# EasyEDA Pro project STM32G303的双FOC电机驱动.eprj, board motor_drivev1.3 (continued)
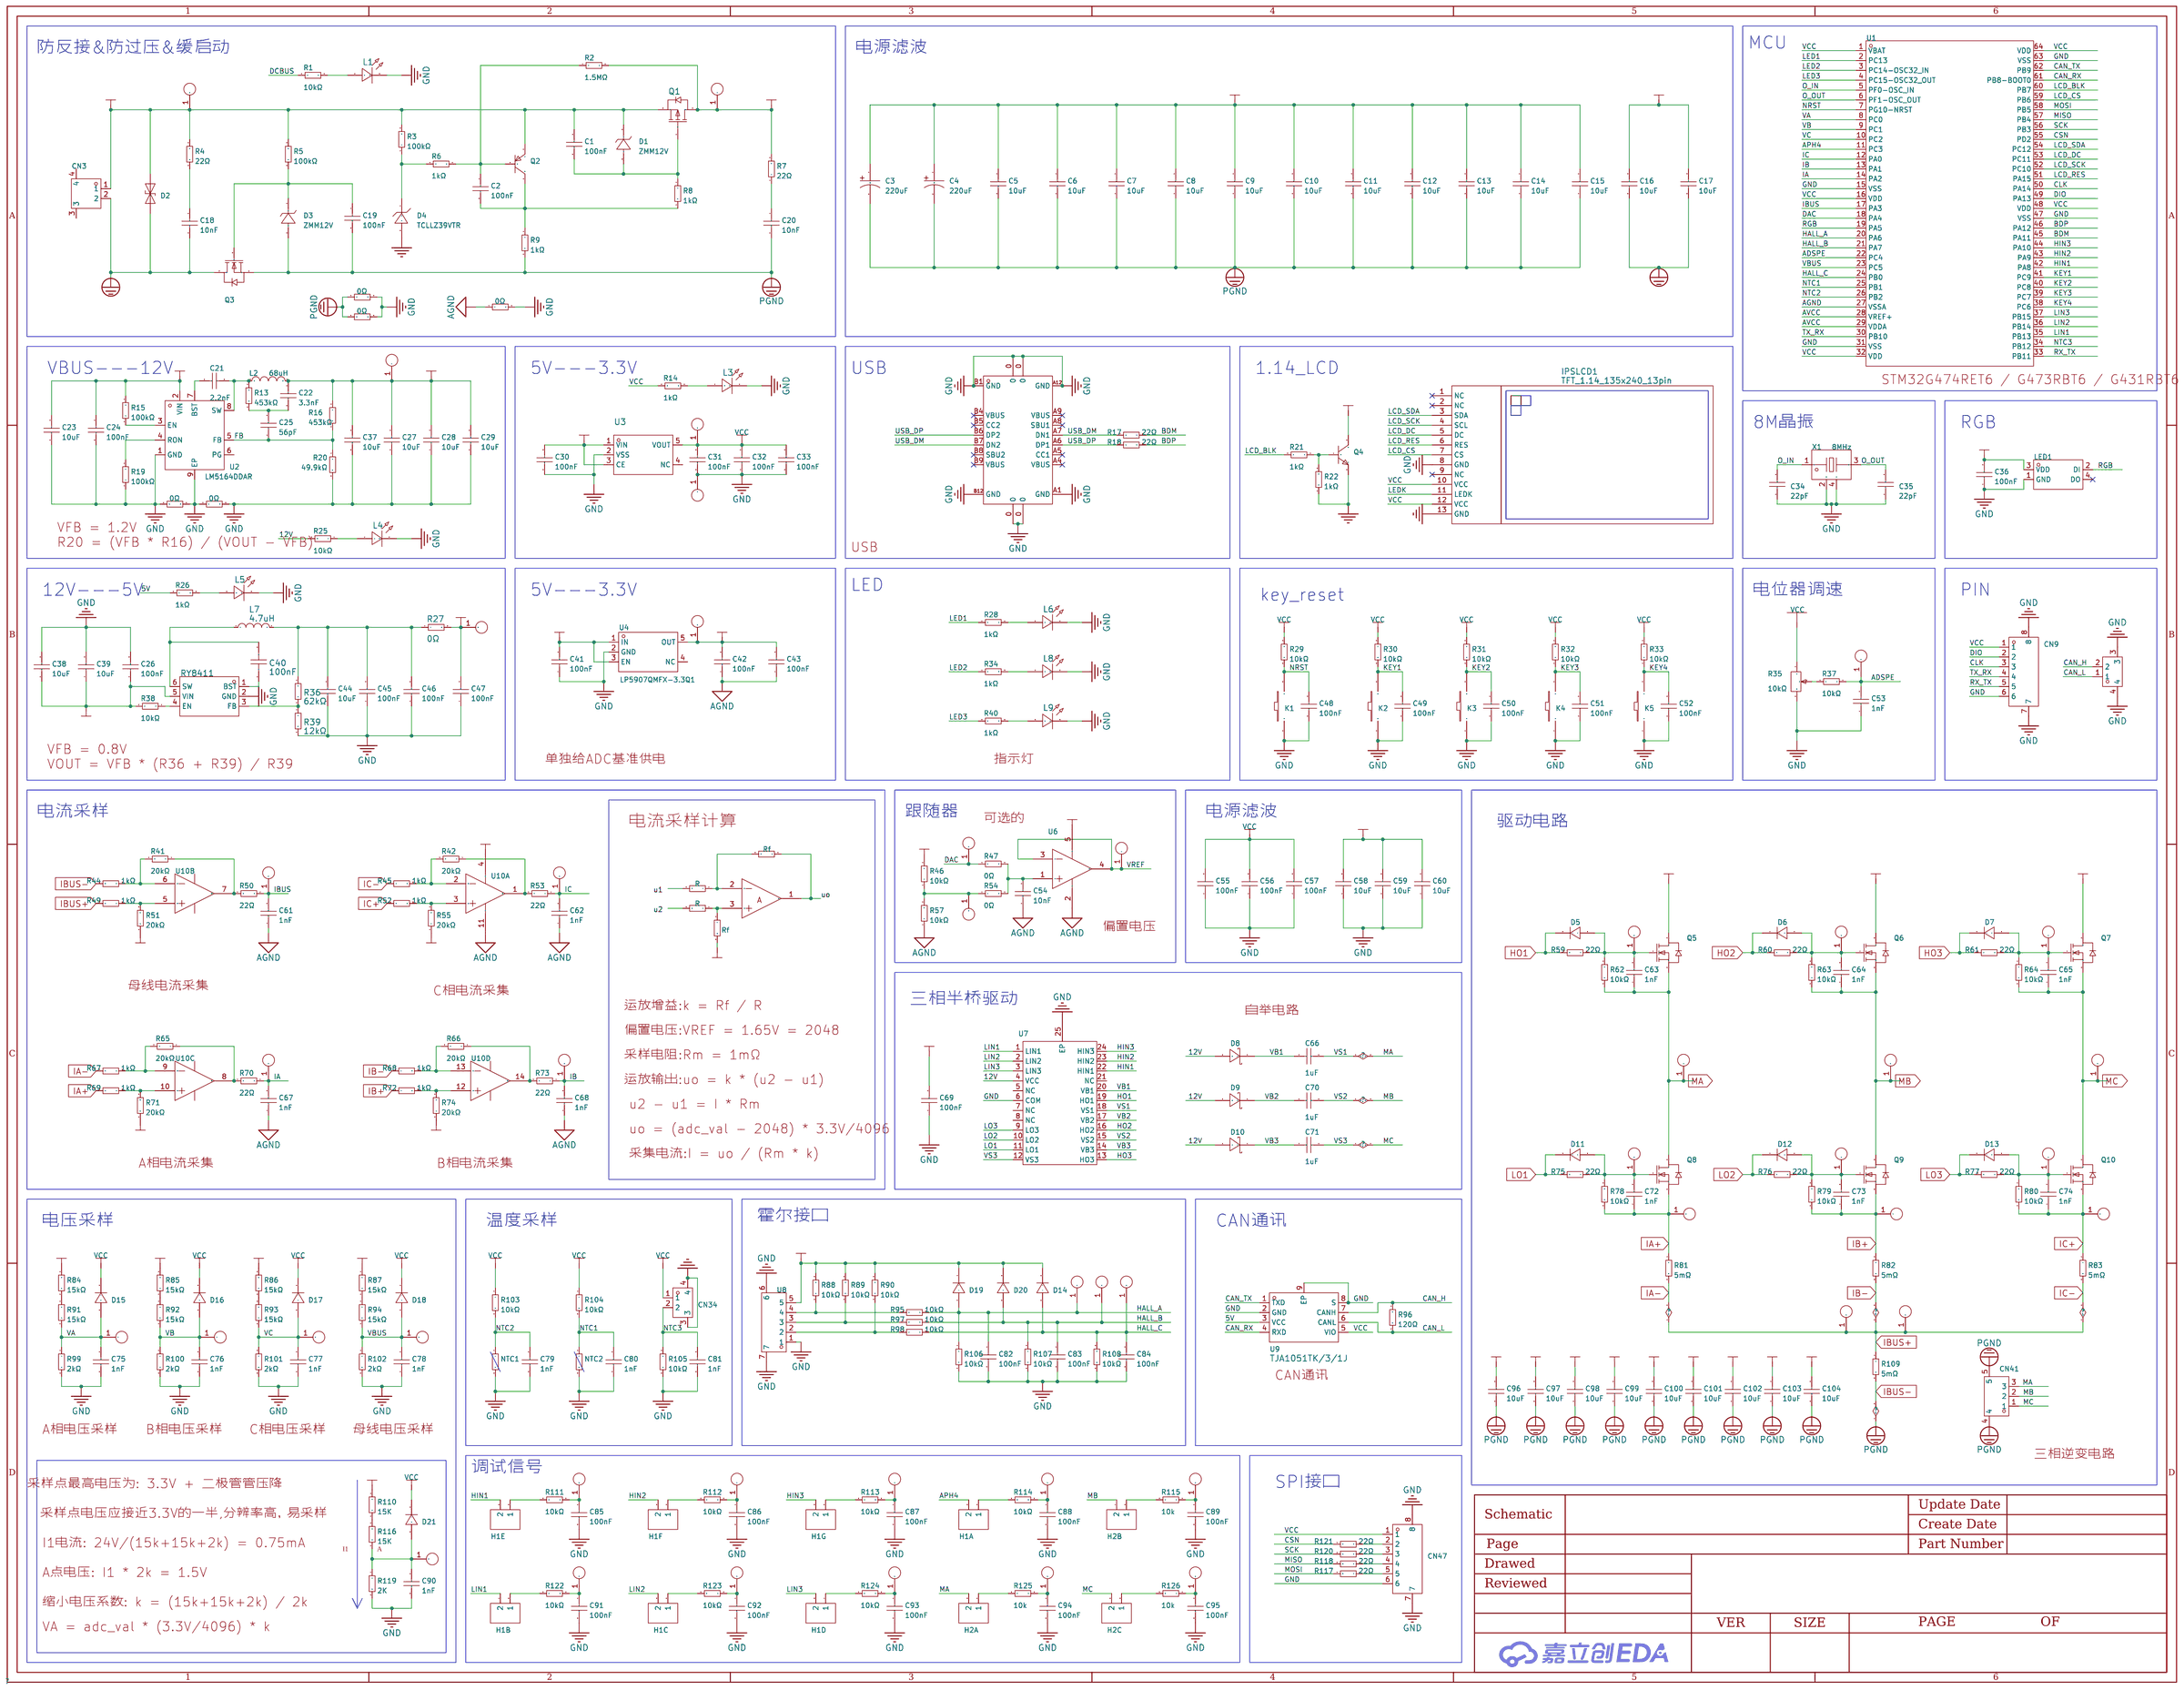
[diagram p0: schematic sheet]
## Footprints (pads in the part's own frame, mm; a bottom-side part is the same pattern mirrored in y, then rotated) (continued)
R2512_S
  rect 1.282x3.456 smd: 1(-3.067,0) 2(3.067,0)
RELAY-TH_G5Q-14-DCXX
  round 1.8 hole 1.2: 1(-8.89,-3.81) 2(1.27,-3.81) 3(8.89,-3.81) 4(6.35,3.81) 5(-8.89,3.81)
SOD-123F_L2.8-W1.7-LS3.7-RD
  rect 1x1.2 smd: 1(-1.55,0) 2(1.55,0)
SOD-123FL_L2.8-W1.8-LS3.7-BI
  rect 1.2x1.4 smd: 1(-1.7,0) 2(1.7,0)
SOD-123FL_L2.8-W1.8-LS3.7-RD
  rect 1.2x1.2 smd: 1(-1.6,0) 2(1.6,0)
SOD-323_L1.8-W1.3-LS2.5-RD
  rect 0.889x0.75 smd: 1(-1.046,0) 2(1.046,0)
SOD-323_L1.8-W1.3-LS2.5-RD#2
  rect 1x0.75 smd: 1(-1.173,0) 2(1.173,0)
SOIC-8_L4.9-W3.9-P1.27-LS6.0-BL
  oval 0.588x2.045 smd: 1(-1.905,-2.772) 2(-0.635,-2.772) 3(0.635,-2.772) 4(1.905,-2.772) 5(1.905,2.772) 6(0.635,2.772) 7(-0.635,2.772) 8(-1.905,2.772)
SOP-8_L4.9-W3.9-P1.27-LS6.0-BL
  oval 0.63x1.865 smd: 1(-1.905,-2.683) 2(-0.635,-2.683) 3(0.635,-2.683) 4(1.905,-2.683) 5(1.905,2.683) 6(0.635,2.683) 7(-0.635,2.683) 8(-1.905,2.683)
SOT-23-3_L2.9-W1.3-P1.90-LS2.4-BR
  rect 1.25x0.7 smd: 1(1,-0.95) 2(1,0.95) 3(-1,0)
SOT-23-3_L2.9-W1.4-P1.90-LS2.4-TR
  rect 1x0.7 smd: 1(1.25,0.95) 2(1.25,-0.95) 3(-1.25,0)
SOT-23-5_L3.0-W1.7-P0.95-LS2.8-BR
  rect 1x0.6 smd: 1(1.3,-0.95) 2(1.3,0) 3(1.3,0.95) 4(-1.3,0.95) 5(-1.3,-0.95)
SOT-23-6_L2.9-W1.6-P0.95-LS2.8-BL
  rect 0.532x1.072 smd: 1(-0.95,-1.149) 2(0,-1.149) 3(0.95,-1.149) 4(0.95,1.149) 5(0,1.149) 6(-0.95,1.149)
SW-SMD_L3.9-W3.0-P4.45
  rect 1.23x1.36 smd: 1(-2.185,0) 2(2.185,0)
Test-Point-0.5mm
  round 0.5 smd: 1(0,0)
TESTPOINT-TH_BD2.0_C9900010656
  round 1.27 smd: 1(0,0)
TSSOP-14_L5.0-W4.4-P0.65-LS6.4-BL
  rect 0.4x1.7 smd: 1(-1.95,-2.8) 2(-1.3,-2.8) 3(-0.65,-2.8) 4(0,-2.8) 5(0.65,-2.8) 6(1.3,-2.8) 7(1.95,-2.8) 8(1.95,2.8) 9(1.3,2.8) 10(0.65,2.8) 11(0,2.8) 12(-0.65,2.8) 13(-1.3,2.8) 14(-1.95,2.8)

## Nets
As in the schematic, except:
PGND: C155.2 C156.1 H1.2 H2.2 NOREF.1 NOREF#2.1

Pads without a net: U3 4; U4 4; U7 5 7 8 21; U22 5 7 8 21; U32 7 11 16 42 43 44 45 54 55 56 60 62 66 70 73 81 82 88 91 96 97 98; U42 2; U50 3 4 5 6 8

## Via types
v1: diameter 0.7, hole 0.35, Top Layer to Bottom Layer, 218 vias
v2: diameter 0.508, hole 0.305, Top Layer to Bottom Layer, 143 vias
v3: diameter 0.61, hole 0.305, Top Layer to Bottom Layer, 7 vias

## Routing (per net, layer and track width the routed paths; a pad name or vN(x,y) marks a point on that pad's centre or on a via; arc(x,y) is an arc through that point)
12V: length 111.6
  Top Layer w0.254: v1(77.46,27.58) 78.22,28.34 78.47,28.34 78.53,28.28 U22.4 ; U7.4 35.36,27.2 33.97,25.81 33.13,25.81
  Top Layer w0.381: v1(28.94,24.91) 29.03,25 29.03,25.81
  Top Layer w0.508: 31.62,33.72 31.62,34.88 R217.1 31.81,36.1 34.72,39.01 v1(37.39,39.01) ; 31.62,33.72 R216.1 R215.1 31.62,26.07 31.35,25.81 ; 31.62,33.72 31.57,33.67 C136.2 ; 31.35,25.81 33.13,25.81 ; 31.35,25.81 27.35,25.81 C138.2 26.66,26.5 C142.2 24.88,26.56 C137.2 22.91,26.44 21.32,26.44 20.43,27.32 U49.2
  Bottom Layer w0.254: v1(77.46,27.58) 77.14,27.58 76.42,28.29 75.81,28.29 75.63,28.47 75.63,29.61 R206.1 73.67,29.74 C69.2 ; Q23.1 35.99,41.49 R200.1 36.31,39.59 R201.1
  Bottom Layer w0.381: R206.1 74.79,30.7 74.79,31.71 75.05,31.97 75.42,31.97 R205.1 75.69,33.23 R204.1 75.37,38.11 70.09,43.39 65.46,43.39 63.8,45.04 56.31,45.04 52.06,40.79 40.01,40.79 38.99,41.81 R200.1 ; 29.9,25.93 28.94,24.97 v1(28.94,24.91)
  Bottom Layer w0.508: R201.1 36.94,39.45 v1(37.39,39.01)
  Bottom Layer w0.762: C133.2 29.9,25.93
+5V: length 242.2
  Top Layer w0.254: v2(68.36,63.88) 68.36,66.52 67.93,66.95 C130.2
  Top Layer w0.381: C41.2 48.14,36.66 C30.2 47.74,39.09 U3.1 47.74,41.55 48.14,41.94 49.57,41.94 49.83,41.67 49.83,40.76 49.64,40.57 54.54,40.57 U4.3 54.66,39.7 54.85,39.52 56.38,39.52 v1(56.69,39.83) 56.69,40.56 U4.1
  Top Layer w0.508: C141.2 86.54,44.72 CN77.1 ; v1(64.25,60.66) 63.3,61.61 ; U47.2 62.99,59.34 61.58,57.93 C129.2
  Top Layer w0.762: C132.2 73.85,64.35 R179.2 72.18,64.34 C140.2 68.82,64.34 v2(68.36,63.88) 67.93,63.45 67.11,63.45 67.11,61.93 66.79,61.61 U47.2
  Inner2 w0.381: 58.66,52.09 56.69,50.12 v1(56.69,39.83)
  Inner2 w0.508: v1(56.69,39.83) 56.44,40.09 53.01,40.09 47.61,34.69 44.95,34.69 44.44,35.2 43.99,35.2 43.36,35.83 42.85,35.83 42.66,35.64 30.02,35.64 27.42,38.25 27.42,41.86 26.58,42.69 16.12,42.69 9.45,36.02 9.45,33.8 8.83,33.18 6.54,33.18 4.18,30.82 4.18,5.42 4.7,4.89 CN75.1 ; 58.66,52.09 64.25,57.68 v1(64.25,60.66)
  Bottom Layer w0.508: v1(64.25,60.66) 65.99,58.92 65.99,54.8 66.35,54.44 70.41,54.44 70.65,54.2 70.99,54.2 71.23,54.44 71.23,56.47 71.81,57.04 71.81,57.61 81.78,57.61 83.68,55.71 83.68,49.55 85.03,48.2 CN77.1 87.19,48.2 89.59,45.8 89.59,32.85 91.11,31.32 91.11,27.39 93.94,24.55 CN76.1
AGND: length 217.8
  Top Layer w0.254: U10.11 51.17,28.85 50.72,28.4 48.21,28.4 47.76,28.85 C68.1 ; C125.1 v1(63.17,20.78) ; 58.92,41.55 59.3,41.17 v1(59.99,41.17) ; U32.20 61.64,46.18 60.5,45.04 59.11,45.04 58.73,44.66 C42.1 C43.1 ; U25.11 68,28.47 66.85,27.32 v1(66.85,27.01)
  Top Layer w0.305: C146.1 38.53,21.04 v1(38.53,20.53) ; C145.1 38.28,14.43 v1(38.6,14.12)
  Top Layer w0.381: v1(48.22,16.88) 47.87,16.53 C62.1 ; v1(53.01,11.77) 52.88,11.89 C54.1 ; v1(64.31,27.7) 63.93,27.7 C127.1 ; 47.3,4.84 47.54,4.61 ; 47.54,4.61 47.54,4.26 v1(47.1,3.83) ; 47.54,4.61 48,4.15 ; C67.1 56.06,31.52 v1(56.06,31.32) ; C148.1 60.76,8.76 60.66,8.67 60.66,3.67 62.6,1.73 72.95,1.73 73.59,2.37 C149.1 ; C144.1 v1(38.98,6.5)
  Top Layer w0.508: 48,4.15 50.85,4.15 54.15,7.45 54.15,9.6 ; 54.09,12.15 54.09,13.16 55.23,14.31 C61.1 ; 54.09,12.15 54.09,11.77 54.15,11.71 54.15,9.6 ; 54.09,12.15 53.79,12.44 52.61,12.44 C54.1 51.99,11.96 U6.2 ; 54.15,9.6 54.21,9.54 C148.1 ; 60.12,40.28 58.73,40.28 ; R57.1 47.3,4.84
  Inner1 w0.254: v1(56.06,31.32) 53.77,29.04 v1(53.77,23.13)
  Inner2 w0.254: v1(63.17,20.78) 63.17,19.26 63.3,19.13
  Inner2 w0.381: v1(53.01,11.77) 55.07,11.77 62.44,19.13 63.3,19.13 66.85,22.69 v1(66.85,27.01)
  Bottom Layer w0.254: v1(38.53,20.53) 38.98,20.08 38.98,13.73 ; v1(56.06,31.32) 56.88,32.15 56.88,34.88 59.99,37.99 v1(59.99,41.17) ; C147.1 65.12,22.12 64.86,22.37 58.22,22.37 57.52,21.67 55.23,21.67 v1(53.77,23.13)
  Bottom Layer w0.305: v1(38.98,6.5) 38.98,13.73 v1(38.6,14.12)
  Bottom Layer w0.381: v1(46.79,28.4) 49.71,31.32 v1(56.06,31.32) 59.68,27.7 63.49,27.7 ; 48.76,17.42 50.09,17.42 53.01,14.5 v1(53.01,11.77) ; 48.76,17.42 v1(48.22,16.88) ; 48.76,17.42 50.09,18.75 50.09,24.66 50.36,24.93 52.08,24.93 53.17,26.02 53.48,26.02 53.84,26.37 62.15,26.37 63.49,27.7 ; 63.49,27.7 v1(64.31,27.7) ; v1(47.1,3.83) 41.64,3.83 v1(38.98,6.5)
AVCC: length 77.2
  Top Layer w0.254: 61.25,38.58 v1(61.77,38.06) ; 61.25,38.58 61.28,38.58 61.9,39.2 61.9,41.42 64.39,43.91 65.47,43.91 65.65,44.09 65.65,45.04 65.01,45.68 U32.21 U32.22 ; 61.25,38.58 C43.2 C42.2 58.23,38.09 U4.5 ; v1(48.57,9.42) 47.37,9.42 R46.2 ; v1(67.55,26.31) 68,25.86 U25.4
  Top Layer w0.381: U10.4 51.17,23.26 v1(51.04,23.13)
  Top Layer w0.508: U6.5 47.36,10.98 R46.2
  Bottom Layer w0.254: v1(67.55,26.31) 67.68,26.44 67.68,29.73 61.77,35.64 v1(61.77,38.06)
  Bottom Layer w0.381: v1(67.55,26.31) 66.73,25.48 53.39,25.48 v1(51.04,23.13) 54.34,19.83 54.34,10.18 53.58,9.42 v1(48.57,9.42)
GND: length 7.8
  Top Layer w0.203: U32.49 75.78,43.11 76.06,43.39 76.63,43.39 76.95,43.07 76.95,42.44 77.97,41.42 79.99,41.42 80.44,40.97 R193.1
  vias: v1(1.77,11.64) v1(1.7,5.1) v1(2.59,11.07) v1(2.55,4.93) v1(12.39,57) v1(12.39,53.37) v1(13.51,56.98) v1(14.08,54.82) v1(15.55,63.52) v1(15.55,62.21) v1(15.61,49.93) v1(17.39,61.23) v1(17.96,63.2) v1(18.09,59.65) v1(18.09,52.15) v1(19.1,61.12) v1(19.1,57.36) v1(19.61,52.91) v1(22.59,49.55) v1(25.32,45.17) v1(25.83,46.63) v1(26.53,30.44) v1(26.88,16.66) v1(27.23,44.91) v1(27.42,29.55) v1(27.67,24.02) v1(29.58,31.13) v1(29.83,23.64) v1(30.21,29.8) v1(30.85,49.61) v1(32.05,50.82) v1(33.01,59.2) v1(33.01,56.85) v1(33.13,45.99) v1(34.47,51.2) v1(34.4,44.98) v1(34.85,49.74) v1(35.55,56.15) v1(36.12,45.8) v1(36.5,60.15) v1(38.72,26.82) v1(39.82,26.82) v1(40.06,60.15) v1(51.8,3) v1(52.12,52.66) v1(52.25,55.07) v1(53.2,38.56) v1(53.2,15.45) v1(53.39,3.57) v1(53.51,55.07) v1(53.51,53.66) v1(53.9,4.15) v1(54.92,42.18) v1(54.98,4.91) v1(55.49,3.13) v1(55.74,3.96) v1(57.51,43.71) v1(57.74,3.13) v1(58.66,4.27) v1(64.8,49.7) v1(65.93,49.7) v1(69.2,66.57) v1(70.33,66.57) v1(73.02,14.7) v1(73.58,62.82) v1(74.35,14.69) v1(75.17,62) v1(75.62,63.39) v1(80,28.66) v1(81.39,27.77) v1(87.55,61.87) v1(87.55,60.46) v1(87.55,9.16) v1(88.63,60.6) v1(88.7,8.02) v1(88.95,62.12) v1(97.27,23.26) v1(97.27,21.03) v1(97.33,29.1) v1(97.33,27.45) v1(97.46,19.07) v1(97.46,17.03) v1(97.46,13.13) v1(97.59,25.29) v1(97.84,10.62)
PGND: length 125.6
  Top Layer w0.508: H2.2 89.1,18.12 87.49,18.12 87.36,17.99 87.36,15.2 C156.1 ; H1.2 11.08,22.82 8.43,22.82 7.23,21.61 7.23,15.77 NOREF.1
  Inner2 w0.508: NOREF.1 22.09,0.91 84.7,0.91 86.16,2.37 NOREF#2.1
  Bottom Layer w0.508: NOREF#2.1 86.28,5.23 86.28,10.43 89.92,14.07 H2.2 ; C155.2 16.5,5.87 NOREF.1
V2_B1: length 5.5
  Top Layer w0.254: U22.20 v2(81.57,31.26)
  Bottom Layer w0.254: C105.2 83.7,33.61 D22.1 81.49,32.98 81.57,32.9 v2(81.57,31.26)
V2_B2: length 7.9
  Top Layer w0.254: U22.17 85.32,29.28 v2(85.71,29.67)
  Bottom Layer w0.254: D23.1 85.35,31.71 C106.2 85.6,30.77 85.71,30.66 v2(85.71,29.67)
V2_B3: length 8.6
  Top Layer w0.254: U22.14 83.67,27.78 83.87,27.58 v2(83.87,27.13)
  Bottom Layer w0.254: 86.06,28.78 86.61,29.34 C107.2 ; 86.06,28.78 84.28,28.78 D24.1 ; 86.06,28.78 84.41,27.13 v2(83.87,27.13)
VBUS: length 2
  Top Layer w0.203: U32.24 61.67,44.18 61.01,43.52
VCC: length 239.6
  Top Layer w0.254: v2(53.2,43.96) 54.17,43.96 U52.3 ; R14.1 48.19,43.62 U3.5 ; R14.1 48.07,44.6 v2(46.98,44.6) ; R14.1 48.19,46.38 C55.2 47.96,46.26 C57.2 45.58,44.15 45.01,43.58 ; v1(66.39,44.83) 66.35,44.83 66.35,43.58 66.09,43.33 65.46,43.33 65.28,43.15 U32.28 ; v1(77.9,56.34) 77.9,55.75 U32.75 ; R190.2 44.68,56.99 45.13,56.53 61.96,56.53 62.66,57.23 U32.100 64.26,57.2 64.26,55.88 64.44,55.7 65.47,55.7 65.65,55.52 65.65,54.12 64.7,53.18 U32.6 ; C150.2 85.59,66.49 C31.2 ; Q26.2 76.95,40.02 76.28,40.69 U32.50 ; 86.54,37.12 85.91,37.75 R196.2
  Top Layer w0.381: v1(86.54,37.67) 86.54,37.12 U41.8 ; U31.8 77.65,64.09 78.57,63.17 86.82,63.17 ; v1(76.31,36.85) 76.95,37.49 Q26.2 ; v1(85.46,58.76) 85.75,59.04 86.55,59.04
  Top Layer w0.508: R173.2 77.91,68.98 77.64,68.98 77.46,68.8 77.46,68.54 77.65,68.34 U31.8 v1(76,66.48) ; R190.2 43.99,54.84 CN90.1 ; v1(49.9,64.73) R175.2 ; R211.2 86.55,59.44 86.22,59.77 86.22,62.57 87.5,63.84 R212.2 87.05,65.36 83.66,68.75 R174.2 ; 45.01,43.58 v1(44.63,43.58)
  Inner1 w0.254: v1(84.76,56.79) 84.76,51.64 83.27,50.15 83.27,46.62 CN81.1
  Inner1 w0.381: v1(86.54,37.67) 86.54,38.06 81.39,43.2 CN81.1
  Inner2 w0.254: v1(84.76,56.79) 83.21,58.34 77.9,58.34 ; 77.9,58.34 77.9,62.63 76.31,64.22 76.31,66.16 v1(76,66.48) ; 77.9,58.34 v1(77.9,56.34) 78.16,56.09 78.16,55.33 76.12,53.3 72.7,53.3 68,48.6 67.68,48.6 65.65,46.56 65.65,45.57 v1(66.39,44.83)
  Inner2 w0.381: v1(86.54,37.67) 85.71,36.85 v1(76.31,36.85)
  Bottom Layer w0.254: C56.2 44.2,44.01 v1(44.63,43.58) ; v2(53.2,43.96) 47.61,43.96 v2(46.98,44.6)
  Bottom Layer w0.381: 91.05,57.8 86.41,57.8 v1(85.46,58.76) ; 91.05,57.8 R208.2 ; 91.05,57.8 89.63,56.39 89.63,51.6 89.9,51.33 90,51.33 92.9,48.44 R207.2
  Bottom Layer w0.508: v1(44.63,43.58) 44.63,56.66 v1(44.76,56.79) 46.34,58.38 46.34,62.06 49.01,64.73 v1(49.9,64.73) 49.96,64.79 74.3,64.79 v1(76,66.48)
BUZZLE: length 20.5
  Top Layer w0.254: U32.90 69.28,55.18 v2(69.33,55.14) ; R191.2 54.34,59.76 v2(54.34,60.28)
  Inner1 w0.254: v2(69.33,55.14) 67.17,57.3 57.33,57.3 v2(54.34,60.28)
CLK: length 15.8
  Top Layer w0.254: CN81.3 81.47,48.66 82.41,48.66 83.05,49.3 83.05,55.84 82.41,56.47 79.49,56.47 78.73,57.23 U32.76
DCBUS: length 390.3
  Top Layer w0.254: 38.28,53.36 38.28,46.88 39.54,45.62 RL1.1 40.5,45.53 40.5,42.06 39.81,41.37 23.53,41.37 23.36,41.55 23.36,44.9 RL1.3 ; 38.28,53.36 38.16,53.49 26.11,53.49 RL2.3 ; 38.28,53.36 38.28,54.55 RL2.1
  Top Layer w0.508: 21.86,68.03 22.88,68.03 U53.1 33.45,66.28 U54.1 56.53,66.16 R178.2 56.7,66.19 57.71,66.19 58.41,66.89 U55.5 ; 21.86,68.03 v1(16.78,68.03) 11.8,68.03 11.29,67.52 8.94,67.52 P1.2 10.86,59 R1.2 ; 21.86,68.03 21.86,57.73 RL2.3 ; U56.5 16.24,31.45 15.68,30.89 R181.2
  Top Layer w0.762: R181.2 10.08,30.89 9.2,31.77 9.2,39.14 9,39.33
  Inner1 w0.762: CN80.3 91.09,63.63 90.09,62.63 90.09,56.72 91.7,55.12 CN78.3
  Inner2 w0.635: CN78.3 91.7,54.59 93.65,56.53 95.94,56.53 97.71,54.76 97.71,42.06 95.9,40.25 94.57,40.25 93.59,39.26 93.59,37.75 U42.5
  Bottom Layer w0.762: 47.1,68.85 48.06,67.9 82.03,67.9 86.3,63.63 CN80.3 ; Q27.8 21.28,8.43 Q29.8 21.11,14.03 21.11,20.53 20.94,20.7 20.94,24.59 17.07,28.47 4.94,28.47 2.21,31.2 2.21,60.79 P1.2 ; D31.1 39.18,43.14 40.31,43.14 40.41,43.24 RL1.1 ; D32.1 40.12,56.39 RL2.1
  Bottom Layer w1.016: Q27.8 20.97,5.91 20.97,2.02 21.96,1.03 77.27,1.03 78.66,2.43 78.66,4.46 80.88,6.68
  vias: v1(16.05,67.27) v1(18.91,67.58) v1(19.42,68.66) v1(20.94,67.39) v1(24.12,68.6) v1(31.74,68.85) v1(32.05,67.39) v1(36.44,68.98) v1(39.99,68.22) v1(41.01,67.14) v1(42.47,67.71) v1(42.72,68.85) v1(44.25,67.14) v1(44.88,68.41) v1(46.28,67.46) v1(47.76,68.41) v1(50.31,68.41) v1(50.31,67.92)
DIO: length 16.6
  Top Layer w0.254: v2(79.43,54.25) 79.35,54.18 U32.72
  Inner2 w0.254: v2(79.43,54.25) 79.93,54.76 79.93,55.96 80.11,56.14 81.51,56.14 81.78,56.41 82.03,56.41 83.05,55.39 83.05,48.39 CN81.2
H2_IN1: length 35.5
  Top Layer w0.254: v1(79.68,49.04) 79.05,49.68 U32.63 ; v2(88.51,33.61) 88.51,32.59 87.87,31.96 80.82,31.96 80.57,31.71 U22.22
  Inner1 w0.254: v1(79.68,49.04) 79.68,46.06 79.49,45.87 79.49,41.36 81.99,38.85 81.97,38.83 81.97,34.5 83.17,33.29 88.19,33.29 v2(88.51,33.61)
H2_IN2: length 26.7
  Top Layer w0.254: U22.23 80.07,32.1 80.38,32.4 82.98,32.4 83.43,32.85 v2(83.43,34.75) ; v2(80.32,49.99) 80.13,50.18 U32.64
  Inner1 w0.254: v2(80.32,49.99) 80.32,43.14 83.87,39.58 83.87,35.2 v2(83.43,34.75)
H2_IN3: length 24.7
  Top Layer w0.254: U32.65 79.66,50.68 79.81,50.82 v2(79.81,50.86) ; v2(79.49,31.07) 79.57,30.99 U22.24
  Inner1 w0.254: v2(79.81,50.86) 79.81,50.24 77.37,47.8 77.37,41.82 79.81,39.39 79.81,32.21 79.49,31.9 v2(79.49,31.07)
H2_O1: length 12.7
  Top Layer w0.254: v2(83.24,30.75) 82.39,30.75 U22.19
  Inner1 w0.254: v2(78.22,24.47) 78.22,25.74 v2(83.24,30.75)
  Bottom Layer w0.254: v2(78.22,24.47) 79.05,23.64 D25.1
  Bottom Layer w0.762: 79.3,23.61 79.53,23.38 R141.2
H2_O2: length 23.9
  Top Layer w0.254: D26.1 78.56,21.98 R142.2 77.52,22.81 v2(77.52,23.51) ; U22.16 83.94,28.78 86.79,25.93 86.79,21.61 v2(86.73,21.55)
  Inner2 w0.254: v2(86.73,21.55) 86.28,21.1 79.93,21.1 v2(77.52,23.51)
H2_O3: length 34.6
  Top Layer w0.254: R143.2 81.04,4.33 D27.1 82.69,3.26 v1(82.73,3.26) ; v2(82.98,24.78) 82.98,27.03 U22.13
  Inner2 w0.254: v2(82.98,24.78) 83.87,25.67 85.08,25.67 87.81,22.94 87.81,14.05 82.73,8.97 v1(82.73,3.26)
HIN1: length 49
  Top Layer w0.254: U32.67 72.54,51.68 72.25,51.96 71.42,51.96 70.28,50.82 v2(68.76,50.82) ; v2(39.2,30.13) 39.04,29.97 U7.22
  Inner1 w0.254: v2(39.2,30.13) 39.2,30.79 58.86,50.44 59.3,50.44 59.68,50.82 v2(68.76,50.82)
HIN2: length 50.4
  Top Layer w0.254: U7.23 38.54,30.14 v2(38.31,30.37) ; v2(68,53.02) 72.21,53.02 73.05,52.18 U32.68
  Inner1 w0.254: v2(38.31,30.37) 38.31,30.47 60.38,52.53 67.51,52.53 v2(68,53.02)
HIN3: length 51.9
  Top Layer w0.254: v2(66.92,53.23) 66.92,53.42 67.11,53.61 72.38,53.61 73.12,52.87 76.88,52.87 77,52.75 77.76,52.75 U32.69 ; v2(37.52,30.12) 38.04,29.59 U7.24
  Inner1 w0.254: v2(37.52,30.12) 37.52,30.75 59.99,53.23 v2(66.92,53.23)
HO1: length 39.6
  Top Layer w0.254: v2(30.79,4.21) D5.1 28.43,4.18 R59.2 ; U7.19 40.54,29.53 v2(40.88,29.86)
  Inner1 w0.254: v2(30.79,4.21) 30.4,4.59 30.4,7.96 32.82,10.37 32.82,12.66 30.4,15.07 30.4,19.2 31.14,19.93 31.14,24.06 31.99,24.91 33.64,24.91 36.26,27.53 36.26,27.72 36.44,27.9 38.91,27.9 v2(40.88,29.86)
HO2: length 46.9
  Top Layer w0.254: v1(27.86,11.13) 28.66,11.13 D6.1 28.78,9.77 R60.2 ; U7.16 43.17,27.7 44.08,26.79 44.08,20.11 41.96,17.99 41.96,6.5 41.07,5.61 v2(41.07,3.45)
  Inner2 w0.254: v2(41.07,3.45) 35.55,3.45 v1(27.86,11.13)
HO3: length 20
  Top Layer w0.254: U7.13 41.39,26.01 41.39,25.04 v2(42.28,24.15) ; R61.2 30.56,16.95 D7.1 30.56,20.75 v2(32.12,22.31)
  Bottom Layer w0.254: v2(32.12,22.31) 33.13,22.31 34.01,23.18 34.01,23.39 41.52,23.39 v2(42.28,24.15)
IA: length 28.1
  Top Layer w0.254: R70.1 57,33.98 C67.2 56.39,33.36 v1(56.12,33.36) ; U32.17 65.93,47.68 66.03,47.77 66.28,47.77 66.6,47.45 v1(66.6,45.93)
  Inner1 w0.254: v1(66.6,45.93) 67.04,45.48 67.04,42.82 66.72,42.5 66.72,41.42 65.83,40.53 v1(65.46,40.53)
  Inner2 w0.254: v1(65.46,40.53) 65.46,39.39 59.42,33.36 v1(56.12,33.36)
IA2: length 24.8
  Top Layer w0.203: v1(72.5,36.15) 73.07,36.15 R165.1 73.71,35.77 74.54,34.94 74.54,33.8 74.03,33.29 74.03,33.05 72.59,31.61 C126.2 ; U32.58 71.85,47.18 v1(71.49,46.82)
  Inner1 w0.203: v1(72.5,36.15) 72.5,39.45 73.08,40.02 73.08,45.23 v1(71.49,46.82)
IA2+: length 28.7
  Top Layer w0.203: R153.1 67.55,37.67 v1(67.61,37.74)
  Top Layer w0.254: v2(70.35,17.04) 70.99,17.04 R134.2 73.2,17.35 C115.1
  Inner1 w0.254: v1(68.31,27.58) 68.31,37.04 v1(67.61,37.74)
  Bottom Layer w0.203: 69.09,17.04 69.2,17.15 R187.1
  Bottom Layer w0.254: v2(70.35,17.04) 69.09,17.04 ; v1(68.31,27.58) 70.35,25.55 70.35,22.53 69.91,22.1 69.91,21.44 R187.1
IA2-: length 49.1
  Top Layer w0.203: v1(60.76,16.4) 60.87,16.28 R148.1
  Top Layer w0.254: v1(70.22,35.58) 69.97,35.82 R151.1 ; v1(73.14,26.82) 73.84,27.51 74.02,27.51 ; v1(62.34,30.63) 62.34,30.11 R152.1
  Inner1 w0.254: 62.34,20.99 v1(62.34,30.63) ; 62.34,20.99 62.34,20.21 62.28,20.15 62.41,20.02 69.84,20.02 73.14,23.32 v1(73.14,26.82) 72.06,27.9 72.06,33.74 v1(70.22,35.58) ; 62.34,20.99 62.01,20.66 v1(61.65,20.66)
  Bottom Layer w0.203: R137.2 61.27,16.91 60.95,16.59
  Bottom Layer w0.254: v1(60.76,16.4) 60.95,16.59 60.95,19.96 v1(61.65,20.66)
IA+: length 54
  Top Layer w0.254: R78.2 34.59,4.78 C72.1 ; 34.16,7.32 v2(32.88,7.32)
  Top Layer w0.381: R184.1 33.83,7 33.83,5.8 34.66,4.97 R78.2 ; R69.1 57.71,27.39 v1(57.84,27.51)
  Bottom Layer w0.254: Q28.2 31.62,7.65 31.94,7.32 v2(32.88,7.32) ; Q28.2 Q28.1 34.87,8.3 R81.1 ; Q28.2 Q28.3
  Bottom Layer w0.381: v1(57.84,27.51) 46.66,27.51 42.02,22.88 39.04,22.88 37.64,21.48 37.64,8.08 36.94,7.38 R81.1
IA-: length 51
  Top Layer w0.254: R67.1 58.14,34.56 v1(58.09,34.56) ; 52.96,16.48 53.03,16.4 v1(53.52,16.4) ; 52.96,16.48 53.52,17.04 53.52,18.31 51.61,20.21 R45.1 ; 52.96,16.48 R49.1 51.61,13.86 v1(51.55,13.8) ; R68.1 v1(45.72,33.17)
  Inner1 w0.254: v1(53.52,16.4) 55.43,18.32 55.43,27.27 57.14,28.97 57.14,31.11 57.06,31.19 58.09,32.21 v1(58.09,34.56) ; v1(43.29,20.66) 42.85,21.1 42.85,24.06 42.95,24.06 43.29,24.4 43.29,26.97 43.33,27.01 43.27,27.01 42.85,27.42 42.85,30.3 v1(45.72,33.17)
  Bottom Layer w0.254: R83.2 42.36,20.66 v1(43.29,20.66) ; v1(51.55,13.8) 49.96,13.8 49.91,13.75 R109.1
IB: length 32.5
  Top Layer w0.254: 45.65,31.52 45.65,31.81 45.58,31.88 44.84,31.88 44.45,32.26 44.45,33.47 44.06,33.86 v1(44.06,34.44) ; v1(59.36,46.25) 60.29,47.18 U32.18
  Top Layer w0.508: C68.2 45.6,31.4 R73.1
  Inner1 w0.254: v1(59.36,46.25) 59.36,47.39 59.42,47.45 57.96,47.45 57.26,46.75 57.26,46.69 52.12,41.55 51.17,41.55 v1(44.06,34.44)
IB2: length 37.4
  Top Layer w0.254: 62.11,28.02 61.62,28.02 60.95,28.7 v2(60.95,31.45) 62.04,31.45 R166.1 ; v2(65.39,48.66) 68.63,48.66 69.61,47.68 U32.59
  Inner1 w0.254: v2(65.39,48.66) 65.39,42.75 60.95,38.31 v2(60.95,31.45)
IB2+: length 23.5
  Top Layer w0.254: C116.1 68.88,11.31 R135.2 67.3,12.21 v2(67.23,12.27) 67.23,12.85 66.35,13.74 R188.1 62.21,13.76 60.06,15.91 60.06,22.5 61.33,23.77 61.85,23.77 R154.1
  Bottom Layer w0.254: R138.1 67.61,12.62 67.57,12.62 v2(67.23,12.27)
IB+: length 65.8
  Top Layer w0.254: v1(34.15,16.08) 33.21,15.14 R185.1 32.94,14.04 R79.2 ; R72.1 51.36,36.91 v1(52.06,37.61) ; v1(31.93,11.39) 32.32,11.39 R79.2 ; R79.2 34.84,12.01 C73.1
  Inner1 w0.254: v1(52.06,37.61) 56.57,37.61 57.84,36.34 57.84,36.09 56.09,34.34 54.25,34.34 46.02,26.12 46.02,24.4 45.2,23.58 45.2,16.21 44.5,15.51 34.79,15.51 34.21,16.08 v1(34.15,16.08)
  Bottom Layer w0.254: v1(31.93,11.39) 32.18,11.64 32.18,13.23 31.41,14 Q30.2 Q30.1 34.81,14.65 R82.1 ; Q30.3 31.14,13.9 31.24,13.9
IBUS: length 34.9
  Top Layer w0.254: v1(56.82,20.4) 57.16,20.4 57.2,20.36 57.19,20.35 R50.1 ; v1(60.57,46.18) 61.06,46.68 U32.19
  Top Layer w0.508: C61.2 R50.1
  Inner1 w0.254: v1(60.57,46.18) 58.66,44.28 58.66,40.66 59.99,39.33 59.99,23.58 v1(56.82,20.4)
IBUS2: length 26.8
  Top Layer w0.254: 71.1,20.22 71.17,20.29 v1(71.17,22.88) ; 71.1,20.22 72.07,20.22 C124.2 ; 71.1,20.22 R163.1 ; v1(64.22,40.44) 64.78,41 U32.27
  Bottom Layer w0.254: v1(64.22,40.44) 65.58,39.07 65.58,34.44 71.17,28.85 v1(71.17,22.88)
IC: length 47.6
  Top Layer w0.254: v1(46.53,22.88) 46.53,20.72 46.98,20.28 47.48,20.28 R53.1 47.61,18.04 ; U32.15 60.84,48.68 60.5,48.34 60.31,48.34 v1(58.22,46.25)
  Inner1 w0.254: v1(58.22,46.25) 58.15,46.18 58.15,40.09 59.42,38.82 59.42,26.11 57.06,23.76 v1(57.06,22.5)
  Inner2 w0.254: v1(57.06,22.5) 56.87,22.31 46.91,22.31 46.53,22.69 v1(46.53,22.88)
IC2: length 40.1
  Top Layer w0.203: R164.1 64.86,20.22 63.36,21.72 C125.2
  Top Layer w0.254: v2(69.08,45.74) 72,45.74 72.93,46.68 U32.57 ; C125.2 63.12,21.67 v2(61.71,21.67)
  Inner1 w0.254: v2(61.71,21.67) 61.71,31.53 65.01,34.83 65.01,38.25 67.76,41 67.76,42.97 69.08,44.28 v2(69.08,45.74)
IC2+: length 25.5
  Top Layer w0.203: R136.2 66.78,5.23 C117.1 70.42,5.23 R189.1 70.47,5.54 71.3,6.37 71.3,8.59 72.31,9.61 72.31,13.8 71.68,14.43 66.64,14.43 64.91,16.16 64.88,16.16
  Top Layer w0.254: 68.37,5.41 68.57,5.61 ; R136.2 v2(66.6,6.5)
  Bottom Layer w0.254: R139.1 67.94,5.92 67.37,6.5 v2(66.6,6.5)
IC+: length 30.3
  Top Layer w0.254: R186.1 33.14,22.55 v1(32.37,23.32) ; v1(45.2,25.04) 45.15,24.98 45.15,24.21
  Top Layer w0.381: v1(34.4,20.34) 34.72,20.02 R80.2 34.65,19.51 C74.1 33.14,19.78 R186.1
  Inner2 w0.254: v1(32.37,23.32) 32.37,29.04 32.75,29.42 34.28,29.42 35.29,28.4 41.67,28.4 41.75,28.49 v1(45.2,25.04)
  Bottom Layer w0.381: R83.1 35.91,20.34 v1(34.4,20.34)
IN1: length 39.9
  Top Layer w0.254: U32.37 69.78,37.98 v1(70.66,37.1)
  Inner2 w0.254: v1(70.66,37.1) 70.85,36.91 73.27,36.91 77.08,40.72 86.35,40.72 86.54,40.92 86.92,40.92 95.75,49.74 v1(95.75,50.12)
  Bottom Layer w0.254: v1(95.75,50.12) 96.31,50.12 R209.1 97.02,48.92 C152.2
IN2: length 45.2
  Top Layer w0.254: U32.38 70.28,44.15 71.23,45.1 v1(75.93,45.1) ; v1(97.97,57.55) 97.46,57.04 v1(88.48,57.04)
  Inner2 w0.254: v1(75.93,45.1) 77.27,45.1 78.79,43.58 82.16,43.58 85.29,46.72 87.51,46.72 88.48,47.69 v1(88.48,57.04)
  Bottom Layer w0.254: R210.1 97.08,57.93 ; 97.08,57.93 97.46,57.55 v1(97.97,57.55) ; 97.08,57.93 C151.2
IN3: length 49.5
  Top Layer w0.254: v1(71.68,38.18) 70.78,39.08 U32.39
  Inner2 w0.254: v1(71.68,38.18) 71.74,38.25 73.27,38.25 76.63,41.61 81.01,41.61 85.71,46.31 87.68,46.31 88.89,47.52 88.89,55.9 92.63,59.65 95.43,59.65 98.16,62.38 v1(98.16,63.01)
  Bottom Layer w0.254: C154.2 98.03,62.69 ; v1(98.16,63.01) 98.16,62.05 98.09,61.98 R213.1
IN4: length 49.1
  Top Layer w0.254: v3(73.08,38.88) 72.76,38.88 72.63,38.75 72.38,38.75 71.28,39.85 U32.40 ; R214.1 89.78,67.83 89.78,68.54 C153.2 88.7,68.66 v1(88.51,68.85)
  Inner1 w0.254: v1(88.51,68.85) 83.62,68.85 81.97,67.2 81.97,62.63 74.53,55.19 73.07,55.19 72.89,55.01 72.89,53.91 73.69,53.11 73.69,39.49 v3(73.08,38.88)
L2_IN1: length 30
  Top Layer w0.254: U22.1 78.22,30.48 v2(78.22,30.56) ; v2(75.6,55.07) 75.28,55.39 U32.78
  Inner1 w0.254: v2(75.6,55.07) 75.04,54.52 75.04,32.72 77.2,30.56 v2(78.22,30.56)
L2_IN2: length 30.8
  Top Layer w0.254: v2(76.12,30.75) 77.6,29.28 U22.2 ; U32.79 74.78,54.88 v2(74.36,54.46)
  Inner1 w0.254: v2(74.36,54.46) 74.36,54.11 74.5,53.97 74.5,32.38 v2(76.12,30.75)
L2_IN3: length 32.3
  Top Layer w0.254: v2(76.63,28.78) 76.64,28.78 U22.3 ; v2(73.52,54.38) 74.28,55.14 U32.80
  Inner1 w0.254: v2(76.63,28.78) 74.09,31.32 74.09,53.8 v2(73.52,54.38)
L2_O1: length 18.9
  Top Layer w0.254: D28.1 69.17,17.7 R144.2 69.89,17.6 v2(70.47,18.18) ; v2(80.51,24.72) 80.95,24.72 81.57,25.34 U22.11
  Inner1 w0.254: v2(80.51,24.72) 76.19,20.4 72.7,20.4 v2(70.47,18.18)
L2_O2: length 27.4
  Top Layer w0.254: U22.10 81.07,25.92 80.57,25.42 80.25,25.42 v2(79.43,24.59) ; v2(64.69,12.66) 64.69,11.38 ; 64.69,11.38 R145.2 ; 64.69,11.38 64.53,11.54 D29.1
  Inner1 w0.254: v2(64.69,12.66) 64.69,14.81 68.69,18.81 70.53,18.81 72.53,20.81 75.64,20.81 v2(79.43,24.59)
L2_O3: length 39.2
  Top Layer w0.254: U22.9 80.57,26.25 80.32,25.99 79.74,25.99 78.79,25.04 77.2,25.04 77.01,24.85 v2(77.01,24.34) ; v2(64.88,7.16) 64.88,6.13 64.82,6.07 R146.2 64.47,5.76 D30.1
  Inner1 w0.254: v2(64.88,7.16) 62.06,7.16 60.95,8.27 60.95,12.59 62.22,13.86 62.22,14.88 66.79,19.45 70.59,19.45 75.48,24.34 v2(77.01,24.34)
LED1: length 29.7
  Top Layer w0.254: U32.8 v2(70.54,52.18) ; R28.2 87.87,42.38 v2(87.87,43.26)
  Bottom Layer w0.254: v2(70.54,52.18) 79.45,43.26 v2(87.87,43.26)
LED2: length 31.7
  Top Layer w0.254: v2(69.52,51.64) 62.77,51.64 U32.9 ; R172.2 87.88,45.22 v2(87.43,45.68)
  Bottom Layer w0.254: v2(87.43,45.68) 85.42,43.67 80.1,43.67 70.73,53.04 70.22,53.04 69.52,52.34 v2(69.52,51.64)
LIN1: length 39.9
  Top Layer w0.254: U7.1 36.8,29.29 v1(36.18,29.29) ; v1(54.22,36.28) 55.11,37.17 64.06,37.17 67.28,40.39 U32.32
  Inner1 w0.254: v1(36.18,29.29) 36.56,28.91 38.79,28.91 40.06,30.18 40.06,30.31 41.77,32.02 41.77,32.09 41.96,32.28 43.79,32.28 44.69,33.18 44.69,34.15 45.52,34.98 46.63,34.98 47.93,36.28 v1(54.22,36.28)
LIN2: length 61.4
  Top Layer w0.254: U32.41 71.78,40.3 v3(72.16,39.93) ; U7.2 35.24,28.2 35.11,28.33 33.65,28.33 v3(33.52,28.47)
  Inner2 w0.254: v3(33.52,28.47) 33.52,27.9 41.71,19.7 58.98,19.7 60.48,21.2 60.48,23.11 60.69,23.32 60.69,27.13 66.66,33.1 66.66,34.44 v3(72.16,39.93)
LIN3: length 55.2
  Top Layer w0.254: U7.3 36.8,27.7 36.8,27.7 v1(34.85,27.7) ; v1(68.69,39.33) 69.28,39.91 U32.36
  Inner2 w0.254: v1(68.69,39.33) 67.68,39.33 59.55,31.2 59.55,24.4 59.74,24.21 59.74,21.93 59.23,21.42 41.14,21.42 v1(34.85,27.7)
LO1: length 24.3
  Top Layer w0.254: D11.1 39.32,3.6 R75.2 38.91,4.05 40.31,5.45 40.31,22.5 40.04,22.77 U7.11
LO2: length 15.6
  Top Layer w0.254: 39.1,10.43 39.2,10.53 D12.1 39.2,13.03 39.29,13.13 39.29,17.14 39.87,17.71 39.87,22.37 39.54,22.69 U7.10
LO3: length 8.3
  Top Layer w0.254: R77.2 39.07,18.22 D13.1 39.36,19.93 39.36,21.8 39.07,22.09 39.07,24.93 39.04,24.96 U7.9
M1_CH1: length 4.7
  Top Layer w0.254: U32.84 72.28,58.47 72.38,58.57 72.82,58.57 73.51,59.26 CN84.1
M1_CH2: length 2.6
  Top Layer w0.254: CN85.1 71.78,59.03 U32.85
M1_OV_1: length 70.9
  Top Layer w0.254: C144.2 R184.2 35.73,7.52 34.6,8.66 32.18,8.66 v1(29.83,11) ; v1(63.42,42.06) 64.21,42.06 U32.26
  Inner2 w0.254: v1(29.83,11) 31.08,12.25 31.44,12.25 31.48,12.3 31.48,15.51 33.07,17.1 33.07,19.17 31.48,20.76 31.48,29.55 33.13,31.2 46.83,31.2 46.84,31.19 52.18,31.19 58.28,37.29 62.73,37.29 64,38.56 64,39.2 63.42,39.77 v1(63.42,42.06)
M1_OV_2: length 53.2
  Top Layer w0.254: R185.2 36.43,14.31 C145.2 v1(36.56,16.21) ; v1(55.93,36.47) 64.57,36.47 68.78,40.68 U32.35
  Inner1 w0.254: v1(36.56,16.21) 42.41,16.21 44.25,18.05 44.25,27.64 51.49,34.88 52.73,34.88 ; v1(55.93,36.47) 54.34,34.88 52.73,34.88 ; v1(52.66,34.95) 52.73,34.88
M1_OV_3: length 63.2
  Top Layer w0.254: U32.48 75.28,39.34 v3(76.06,38.56) ; C146.2 36.37,21.67 R186.2 34.65,22.36 34.79,22.49 v3(34.79,25.04)
  Inner2 w0.254: v3(34.79,25.04) 35.42,25.04 41.38,19.08 59.83,19.08 60.88,20.14 60.88,21.8 62.36,23.28 62.73,23.28 65.33,25.87 65.33,28.15 66.85,29.67 67.17,29.67 v3(76.06,38.56)
M2_CH1: length 5.5
  Top Layer w0.254: U32.92 68.28,59.42 69.61,60.75 CN82.1
M2_CH2: length 12.8
  Top Layer w0.254: v2(76.06,54.25) 76.63,53.68 U32.71
  Inner1 w0.254: v2(82.98,60.53) 82.98,59.9 77.33,54.25 v2(76.06,54.25)
  Bottom Layer w0.254: v2(82.98,60.53) CN83.1
M2_OV_1: length 37.4
  Top Layer w0.254: v2(69.84,48.68) U32.61
  Inner1 w0.254: v2(69.84,48.68) 69.84,38.12 69.27,37.55 69.27,27.04 69.84,26.47 69.84,23.7 v2(69.08,22.94)
  Bottom Layer w0.203: R187.2 69.08,22.12 C147.2
  Bottom Layer w0.254: R187.2 69.08,22.36 v2(69.08,22.94)
M2_OV_2: length 45.4
  Top Layer w0.254: C148.2 60.76,13.68 R188.2 60.7,14.42 58.98,16.14 v3(58.98,23.77) ; v3(72,44.3) 76.95,44.3 77,44.25 77.76,44.25 U32.52
  Inner2 w0.254: v3(58.98,23.77) 58.98,31.29 v3(72,44.3)
M2_OV_3: length 59.6
  Top Layer w0.254: v1(59.55,43.64) 60.06,43.64 61.09,44.68 U32.23 ; v1(72.7,4.65) 72.19,4.15 C149.2 71.99,3.77 R189.2
  Inner2 w0.254: v1(76.19,27.58) 76.19,24.59 70.85,19.26 70.85,19.01 71.74,18.12 71.74,5.04 72.12,4.65 v1(72.7,4.65)
  Bottom Layer w0.254: v1(76.19,27.58) 74.03,27.58 72.02,29.58 72.02,33.84 71.61,34.25 71.61,35.08 67.31,39.37 67.31,39.96 65.89,41.39 65.79,41.29 61.9,41.29 v1(59.55,43.64)
MA: length 74.5
  Top Layer w0.254: U7.18 42.21,29.71 42.21,29.74 42.15,29.8 42.15,31.01 41.96,31.2 C66.1 41.52,30.69 v1(41.52,30.5)
  Top Layer w0.508: R62.2 24.55,4.01 C63.1 24.63,7.07 24.5,7.19
  Top Layer w0.762: v2(25.96,7.51) 21.96,7.51 15.58,13.89 13.16,13.89 12.62,14.43 12.62,17.71 H1.1
  Inner1 w0.254: v1(41.52,30.5) 41.58,30.44 41.58,20.15 39.36,17.93 34.47,17.93 33.45,16.91 33.45,9.67 31.67,7.89 v1(31.67,4.91)
  Bottom Layer w0.254: v2(29.32,6.94) 29.59,6.68 29.59,5.28 29.77,5.1 31.48,5.1 v1(31.67,4.91) ; Q28.7 23.97,7.65
  Bottom Layer w0.762: v2(25.96,7.51) 26.15,7.32 28.26,7.32
  vias: v2(25.58,8.15) v2(26.59,6.24) v2(26.87,8.15) v2(27.29,6.5) v2(29.08,8.13)
MA2: length 57.1
  Top Layer w0.254: U22.18 84.17,29.78 85.2,30.82 86.45,30.82 87.93,29.33 87.93,26.56 89.92,24.57 H2.1 89.97,23.18 89.97,25.29 92,27.32 R131.2 92.01,27.51 C112.1
  Bottom Layer w0.254: 89.92,24.13 89.92,27.82 89.05,28.69 89.05,31.41 86.92,33.55 C105.1
  Bottom Layer w0.762: 89.92,24.13 87.87,26.18 81.97,26.18 81.33,25.55 75.62,25.55 74.2,24.13 Q34.8
MB: length 55
  Top Layer w0.254: U7.15 42.72,27.2 43.42,26.5 v2(43.42,22.94) 40.95,20.47 v1(40.95,17.42) ; v2(43.48,28.47) 43.48,31.52 41.8,33.2 41.14,33.2 C70.1
  Top Layer w0.508: C64.1 22.4,14.37 ; R63.2 24.24,13.99 24.12,14.12
  Top Layer w0.762: v2(26.88,14.47) v2(24.34,14.47) 19.87,18.94 H1.3
  Inner1 w0.254: v2(43.42,22.94) 43.74,23.26 43.74,28.21 v2(43.48,28.47) ; v1(35.36,16.85) 40.37,16.85 v1(40.95,17.42)
  Bottom Layer w0.254: v2(26.88,14.47) 27.32,14.47 29.71,16.85 v1(35.36,16.85)
  vias: v2(24.75,13.93) v2(25.13,12.97) v2(25.45,14.75) v2(25.76,13.74) v2(26.15,12.72) v2(26.88,13.74) v2(27.1,13.04) v2(28.88,14.47)
